# EasyEDA Pro project 电子指南针-git.eprj, schematic Schematic1_4
Create Date: 2024-09-02; Page Name: P1; Project Name: 电子指南针-git; Schematic Name: Schematic1_4; Update Date: 2024-09-07; Company: 嘉立创EDA; Page Size: A4; Version: V1.0
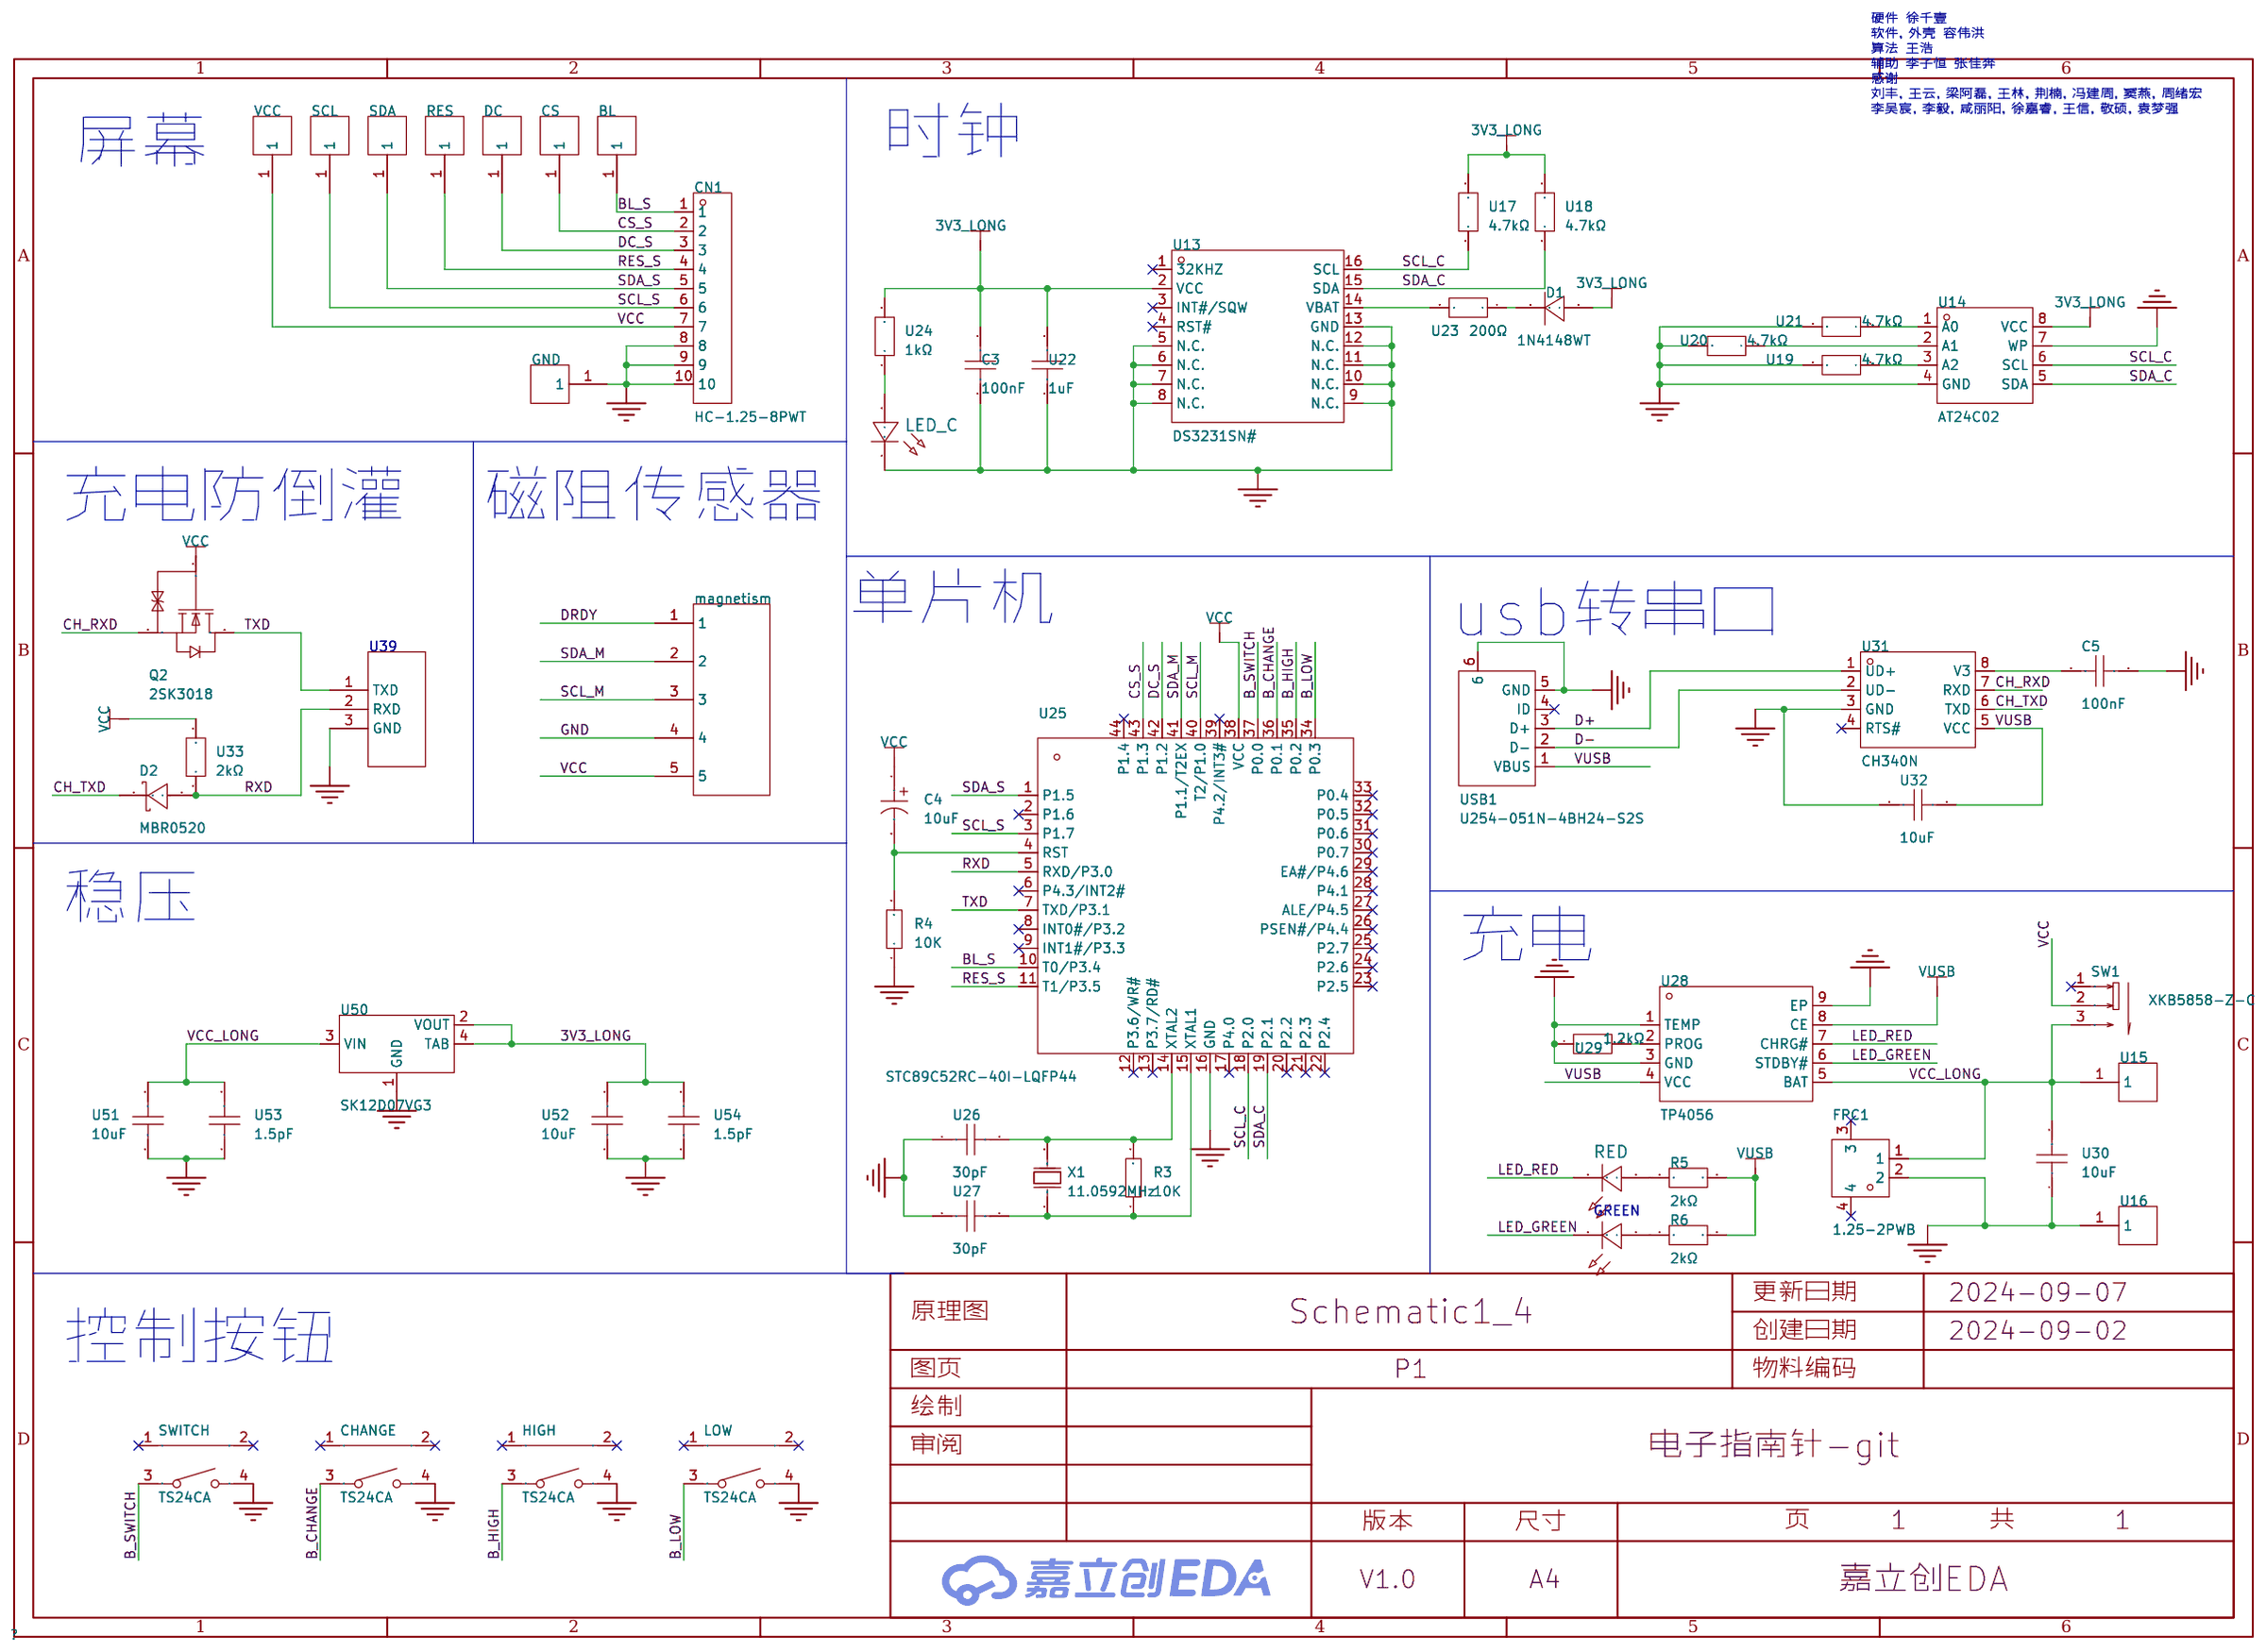
[diagram p1: schematic sheet]

## Parts
BL  -  [mini焊盘]
C3  100nF  [C0603]
C4  10uF  [CAP-SMD_BD5.0-L5.3-W5.3-FD]
C5  100nF  [C0603]
CHANGE  TS24CA  [SW-SMD_TS24CA]
CN1  HC-1.25-8PWT  [CONN-SMD_HC-1.25-8PWT]
CS  -  [mini焊盘]
D1  1N4148WT  [SOD-523_L1.2-W0.8-LS1.6-RD]
D2  MBR0520  [SOD-123_L2.8-W1.8-LS3.7-RD]
DC  -  [mini焊盘]
FPC1  1.25-2PWB  [CONN-SMD_2P-P1.25_DEALON_1.25-2PWB]
GND  -  [mini焊盘]
GREEN  -  [LED_0603]
HIGH  TS24CA  [SW-SMD_TS24CA]
LED_C  -  [LED_0603]
LOW  TS24CA  [SW-SMD_TS24CA]
magnetism  -  [5插件焊盘 间距2.6mm]
Q2  2SK3018  [SOT-23-3_L2.9-W1.3-P1.90-LS2.4-BR]
R3  10K  [R0603]
R4  10K  [R0603]
R5  2kΩ  [R0603]
R6  2kΩ  [R0603]
RED  -  [LED_0603]
RES  -  [mini焊盘]
SCL  -  [mini焊盘]
SDA  -  [mini焊盘]
SW1  XKB5858-Z-C  [SW-TH_XKB5858-Z-C]
SWITCH  TS24CA  [SW-SMD_TS24CA]
U13  DS3231SN#  [SOIC-16_L10.3-W7.5-P1.27-LS10.3-BL]
U14  AT24C02  [SOP-8_L5.0-W4.0-P1.27-LS6.0-BL]
U15  -  [小焊盘]
U16  -  [小焊盘]
U17  4.7kΩ  [R0603]
U18  4.7kΩ  [R0603]
U19  4.7kΩ  [R0603]
U20  4.7kΩ  [R0603]
U21  4.7kΩ  [R0603]
U22  1uF  [C0603]
U23  200Ω  [R0603]
U24  1kΩ  [R0603]
U25  STC89C52RC-40I-LQFP44  [LQFP-44_L10.0-W10.0-P0.80-LS12.0-BL]
U26  30pF  [C0603]
U27  30pF  [C0603]
U28  TP4056  [ESOP-8_L4.9-W3.9-P1.27-LS6.0-BL-EP]
U29  1.2kΩ  [R0603]
U30  10uF  [C0603]
U31  CH340N  [SOP-8_L4.9-W3.9-P1.27-LS6.0-BL]
U32  10uF  [C0603]
U33  2kΩ  [R0603]
U39  -  [下载调试点]
U50  SK12D07VG3  [SOT-223-4_L6.5-W3.5-P2.30-LS7.0-BR]
U51  10uF  [C0603]
U52  10uF  [C0603]
U53  1.5pF  [C0603]
U54  1.5pF  [C0603]
USB1  U254-051N-4BH24-S2S  [MICRO-USB-SMD_U254-051N-4BH24-S2]
VCC  -  [mini焊盘]
X1  11.0592MHz  [OSC-SMD_L5.0-W3.2]

## Library data of the parts
BL CS DC GND RES SCL SDA VCC = mini焊盘
C3 C5 = CC0603MRX7R8BB104: 容值:100nF;精度:±20%;额定电压:25V;材质(温度系数):X7R;; LCSC Part Name: 100nF ±20% 25V; Supplier Part: C2168700; Manufacturer: YAGEO(国巨); Supplier Footprint: 0603; JLCPCB Part Class: 扩展库; Datasheet: https://atta.szlcsc.com/upload/public/pdf/source/20210719/C2168700_6F9BA09EFF30F5F4DF080A6176FF7130.pdf; Supplier: LCSC; Tolerance: ±20%; Voltage Rated: 25V; Temperature Coefficient: X7R
C4 = RST10UF50V016: 容值:10uF;精度:±20%;额定电压:50V;纹波电流:24mA@120Hz;等效串联电阻:-;; LCSC Part Name: 10uF ±20% 50V; Supplier Part: C4747971; Manufacturer: KNSCHA(科尼盛); Supplier Footprint: SMD,D5xL5.4mm; Datasheet: https://atta.szlcsc.com/upload/public/pdf/source/20220722/47144637C831FC4476CE4962252D8002.pdf; Supplier: LCSC; Tolerance: ±20%; Rated Voltage: 50V; Ripple Current: 24mA@120Hz; φD: 5mm; L: 5.4mm; Lifetime @ Temp: 2000hrs@105℃; Operating Temperature: -40℃~+105℃
CHANGE HIGH LOW SWITCH = TS24CA: 电路结构:单刀单掷;按钮形状:矩形按钮;安装方式:卧贴;开关长度:4.55mm;开关宽度:1.8mm;开关高度:3.5mm;触点电流:50mA;额定电压(DC):12V;带灯:-;机械寿命:-;; LCSC Part Name: 4.55*1.8*3.5mm 卧贴 轻触开关; Supplier Part: C393942; Manufacturer: SHOU HAN(首韩); Supplier Footprint: SMD; JLCPCB Part Class: 扩展库; Datasheet: https://atta.szlcsc.com/upload/public/pdf/source/20190521/C393942_591A9E318887EFA4274D34029981AD99.pdf; Supplier: LCSC; Circuit: 单刀单掷; Actuator Style: 矩形按钮; Mounting Style: 卧贴; Switch Length: 4.55mm; Switch Width: 1.8mm; Switch Height: 3.5mm; Contact Current: 50mA; Voltage Rating (DC): 12V
CN1 = HC-1.25-8PWT: 插针结构:1x8P;间距:1.25mm;安装方式:卧贴;参考系列:-;总PIN数:8P;排数:1;每排PIN数:8;行距:-;额定电流:2A;触头材质:黄铜;触头镀层:锡;工作温度范围:-25℃~+85℃;; LCSC Part Name: 1x8P 间距:1.25mm 卧贴; Supplier Part: C2845385; Manufacturer: HCTL(华灿天禄); Supplier Footprint: SMD,P=1.25mm,卧贴; JLCPCB Part Class: 扩展库; Datasheet: https://atta.szlcsc.com/upload/public/pdf/source/20230707/D26CCCA63A4ED0B68E63A615510D7FF9.pdf; Supplier: LCSC; Pins Structure: 1x8P; Pitch: 1.25mm; Mounting Style: 卧贴; Number of Pins: 8P; Number of Rows: 1; Number of PINs Per Row: 8; Current Rating (Max): 2A; Contact Material: 黄铜; Contact Plating: 锡; Operating Temperature Range: -25℃~+85℃
D1 = 1N4148WT_C511874: 二极管配置:独立式;正向压降(Vf):1.25V@100mA;直流反向耐压(Vr):75V;平均整流电流(Io):150mA;功率:500mW;反向恢复时间(trr):4ns;; LCSC Part Name: 电压:75V 电流:150mA; Supplier Part: C511874; Manufacturer: BORN(伯恩半导体); Supplier Footprint: SOD-523; JLCPCB Part Class: 扩展库; Datasheet: https://atta.szlcsc.com/upload/public/pdf/source/20231124/700D00FEEEDC0BE57164827DCFA7C3B0.pdf; Supplier: LCSC; Diode Configuration: 独立式; Forward Voltage (Vf@If): 1.25V@100mA; Reverse Voltage (Vr): 75V; Average Rectified Current (Io): 150mA; Power Dissipation: 500mW; Reverse Leakage Current: 5uA@75V; Reverse Recovery Time (trr): 4ns
D2 = MBR0520_C77335: 正向压降(Vf):450mV@500mA;直流反向耐压(Vr):20V;平均整流电流(Io):500mA;; LCSC Part Name: 电压:20V 电流:500mA; Supplier Part: C77335; Manufacturer: CJ(江苏长电/长晶); Supplier Footprint: SOD-123; JLCPCB Part Class: 扩展库; Datasheet: https://atta.szlcsc.com/upload/public/pdf/source/20160702/1467448303432.pdf; Supplier: LCSC; Forward Voltage (Vf@If): 450mV@500mA; Reverse Voltage (Vr): 20V; Average Rectified Current (Io): 500mA
FPC1 = 1.25-2PWB: 插针结构:1x2P;间距:1.25mm;安装方式:卧贴;参考系列:-;总PIN数:2P;排数:1;每排PIN数:2;行距:-;额定电流:-;工作温度范围:-40℃~+85℃;; LCSC Part Name: 1x2P 间距:1.25mm 卧贴; Supplier Part: C2905009; Manufacturer: DEALON(德艺隆); Supplier Footprint: SMD,P=1.25mm,卧贴; JLCPCB Part Class: 扩展库; Datasheet: https://atta.szlcsc.com/upload/public/pdf/source/20231123/1AE0876AE9C7DCFC0D68EAC4CBA881B0.pdf; Supplier: LCSC; Pins Structure: 1x2P; Pitch: 1.25mm; Mounting Style: 卧贴; Number of Pins: 2P; Number of Rows: 1; Number of PINs Per Row: 2; Operating Temperature Range: -40℃~+85℃
GREEN = LED_0603-G: Supplier Footprint: 0603
LED_C RED = LED_0603-R: Supplier Footprint: 0603
magnetism = 5插件焊盘 间距2.6mm
Q2 = 2SK3018_C8562: 类型:1个N沟道;漏源电压(Vdss):30V;连续漏极电流(Id):100mA;功率(Pd):350mW;导通电阻(RDS(on)@Vgs,Id):8Ω@4V,10mA;阈值电压(Vgs(th)@Id):1.5V@100uA;; LCSC Part Name: 1个N沟道 耐压:30V 电流:100mA; Supplier Part: C8562; Manufacturer: CJ(江苏长电/长晶); Supplier Footprint: SOT-23; JLCPCB Part Class: 扩展库; Datasheet: https://atta.szlcsc.com/upload/public/pdf/source/20140809/1457707215233.pdf; Supplier: LCSC; Type: 1个N沟道; Drain Source Voltage (Vdss): 30V; Continuous Drain Current (Id): 100mA; Power Dissipation (Pd): 350mW; Drain Source On Resistance (RDS(on)@Vgs,Id): 8Ω@4V,10mA; Gate Threshold Voltage (Vgs(th)@Id): 1.5V@100uA
R3 R4 = Res_0603: Supplier Footprint: 0603
R5 R6 = PTFR0603Q2K00N9: 电阻类型:薄膜电阻;阻值:2kΩ;精度:±0.02%;功率:100mW;最大工作电压:100V;温度系数:±10ppm/℃;; LCSC Part Name: 薄膜电阻 2kΩ ±0.02% 100mW; Supplier Part: C23067435; Manufacturer: RESI(开步睿思); Supplier Footprint: 0603; Datasheet: https://atta.szlcsc.com/upload/public/pdf/source/20240628/611D196B6AD2D0BC173B189B37FFA8DD.pdf; Supplier: LCSC; Type: 薄膜电阻; Tolerance: ±0.02%; Power(Watts): 100mW; Overload Voltage (Max): 100V; Temperature Coefficient: ±10ppm/℃; Operating Temperature Range: -55℃~+155℃
SW1 = XKB5858-Z-C: 电路结构:-;自锁/无锁:自锁;安装方式:卧插;触点电流:100mA;额定电压 (AC):250V;额定电压 (DC):30V;带灯:不带;作用力:160gf;机械寿命:1万次;; LCSC Part Name: 按键开关  5.8*5.8侧边插脚自锁; Supplier Part: C318865; Manufacturer: XKB Connectivity(中国星坤); Supplier Footprint: 插件; JLCPCB Part Class: 扩展库; Datasheet: https://atta.szlcsc.com/upload/public/pdf/source/20200227/C318865_806C1898A28533892EA4A080484E0BBB.pdf; Supplier: LCSC; Self Lock / No Lock: 自锁; Actuator Style: 矩形按钮; Mounting Style: 卧插; Contact Current: 100mA; Voltage Rating (AC): 250V; Voltage Rating (DC): 30V; Insulation Resistance: 100MΩ; Actuator/Cap Color: 白色; With Lamp: 不带; Pin Style: PC引脚; Operating Force: 160gf; Operating Temperature: -15℃~+55℃; Mechanical Life: 1万次
U13 = DS3231SN#: 接口:I2C;; Supplier Part: C722469; Manufacturer: ADI(亚德诺)/MAXIM(美信); Supplier Footprint: SOIC-16-300mil; JLCPCB Part Class: 扩展库; Datasheet: https://atta.szlcsc.com/upload/public/pdf/source/20170713/C118524_1499918908819816807.pdf; Supplier: LCSC; Interface: I2C; Operating Voltage: 2.3V~5.5V; Operating Temperature: -40℃~+85℃
U14 = AT24C02_C688857: Supplier Part: C688857; Manufacturer: IDCHIP(英锐芯); Supplier Footprint: SOP-8; JLCPCB Part Class: 扩展库; Datasheet: https://atta.szlcsc.com/upload/public/pdf/source/20200619/C688857_168265888F77B455D6D4136881F4BB15.pdf; Supplier: LCSC
U15 U16 = 小焊盘
U17-U21 = TD03H4701BT: 电阻类型:薄膜电阻;阻值:4.7kΩ;精度:±0.1%;功率:100mW;最大工作电压:-;温度系数:±50ppm/℃;; LCSC Part Name: 薄膜电阻 4.7kΩ ±0.1% 100mW; Supplier Part: C2961385; Manufacturer: FH(风华); Supplier Footprint: 0603; JLCPCB Part Class: 扩展库; Datasheet: https://atta.szlcsc.com/upload/public/pdf/source/20200814/C723338_D21265282435396FB133F134A60939A5.pdf; Supplier: LCSC; Type: 薄膜电阻; Tolerance: ±0.1%; Power(Watts): 100mW; Temperature Coefficient: ±50ppm/℃; Operating Temperature Range: -55℃~+155℃
U22 = TCC0603X7R105K500CT: 容值:1uF;精度:±10%;额定电压:50V;材质(温度系数):X7R;; LCSC Part Name: 1uF ±10% 50V; Supplier Part: C5360793; Manufacturer: CCTC(三环); Supplier Footprint: 0603; JLCPCB Part Class: 扩展库; Datasheet: https://atta.szlcsc.com/upload/public/pdf/source/20191203/C466239_F62A586702D44EEA1C39B32FC8662B21.pdf; Supplier: LCSC; Tolerance: ±10%; Voltage Rated: 50V; Temperature Coefficient: X7R
U23 = CRCW0603200RFKEAHP: 电阻类型:厚膜电阻;阻值:200Ω;精度:±1%;功率:333mW;温度系数:±100ppm/℃;; LCSC Part Name: 厚膜电阻 200Ω ±1% 333mW; Supplier Part: C313701; Manufacturer: VISHAY(威世); Supplier Footprint: 0603; JLCPCB Part Class: 扩展库; Datasheet: https://atta.szlcsc.com/upload/public/pdf/source/20220523/F81E80130AF826FE1224249A473E2E22.pdf; Supplier: LCSC; Type: 厚膜电阻; Tolerance: ±1%; Power(Watts): 333mW; Temperature Coefficient: ±100ppm/℃; Operating Temperature Range: -55℃~+155℃
U24 = CRCW06031K00JNEAC: 电阻类型:厚膜电阻;阻值:1kΩ;精度:±5%;功率:100mW;最大工作电压:75V;温度系数:±200ppm/℃;; LCSC Part Name: 厚膜电阻 1kΩ ±5% 100mW; Supplier Part: C844135; Manufacturer: VISHAY(威世); Supplier Footprint: 0603; JLCPCB Part Class: 扩展库; Datasheet: https://atta.szlcsc.com/upload/public/pdf/source/20210813/0DF91ED8A55BB3B23A2DB757E3871E21.pdf; Supplier: LCSC; Type: 厚膜电阻; Tolerance: ±5%; Power(Watts): 100mW; Overload Voltage (Max): 75V; Temperature Coefficient: ±200ppm/℃; Operating Temperature Range: -55℃~+155℃
U25 = STC89C52RC-40I-LQFP44: CPU内核:51系列;程序存储容量:8KB;RAM总容量:512Byte;GPIO端口数量:39;工作电压范围:3.3V~5.5V;CPU最大主频:-;程序存储器类型:FLASH;; Supplier Part: C8707; Manufacturer: STC(宏晶); Supplier Footprint: LQFP-44(10x10); Datasheet: https://atta.szlcsc.com/upload/public/pdf/source/20131218/1457706663573.pdf; Supplier: LCSC; CPU Core: 51系列; Program Storage Size: 8KB; RAM Size: 512Byte; GPIO Ports Number: 39; Operating Voltage Range: 3.3V~5.5V; Program Memory Type: FLASH; Operating Temperature Range: -40℃~+85℃; 16Bit Timer: 3; UART/USART: 1; Peripheral/Function: 看门狗; Watchdog: 有
U26 U27 = FCC0603N300J500CT: 容值:30pF;精度:±5%;额定电压:50V;材质(温度系数):C0G;; LCSC Part Name: 30pF ±5% 50V; Supplier Part: C7419422; Manufacturer: FOJAN(富捷); Supplier Footprint: 0603; Datasheet: https://atta.szlcsc.com/upload/public/pdf/source/20230926/96CBFEAC228090559554C216363F8731.pdf; Supplier: LCSC; Tolerance: ±5%; Voltage Rated: 50V; Temperature Coefficient: C0G
U28 = TP4056_C382139: LCSC Part Name: 1A锂电池充电IC; Supplier Part: C382139; Manufacturer: TPOWER(天源); Supplier Footprint: ESOP-8; JLCPCB Part Class: 扩展库; Datasheet: https://atta.szlcsc.com/upload/public/pdf/source/20190327/C382139_EC85960E6FE3E26856C240C81751A184.pdf; Supplier: LCSC
U29 = RT0603BRB071K2L: 电阻类型:薄膜电阻;阻值:1.2kΩ;精度:±0.1%;功率:100mW;温度系数:±10ppm/℃;; LCSC Part Name: 薄膜电阻 1.2kΩ ±0.1% 100mW; Supplier Part: C860190; Manufacturer: YAGEO(国巨); Supplier Footprint: 0603; JLCPCB Part Class: 扩展库; Datasheet: https://atta.szlcsc.com/upload/public/pdf/source/20200610/C326738_5639A9F1B6EB6E4AE2197577D3456E7F.pdf; Supplier: LCSC; Type: 薄膜电阻; Tolerance: ±0.1%; Power(Watts): 100mW; Temperature Coefficient: ±10ppm/℃; Operating Temperature Range: -55℃~+155℃
U30 U32 U51 U52 = HGC0603R5106M350NTHJ: 容值:10uF;精度:±20%;额定电压:35V;材质(温度系数):X5R;; LCSC Part Name: 10uF ±20% 35V; Supplier Part: C22367827; Manufacturer: Chinocera(华瓷); Supplier Footprint: 0603; JLCPCB Part Class: 扩展库; Datasheet: https://atta.szlcsc.com/upload/public/pdf/source/20240326/08136F0414FFF46DD07E47F2D66E675E.pdf; Supplier: LCSC; Tolerance: ±20%; Voltage Rated: 35V; Temperature Coefficient: X5R
U31 = CH340N: LCSC Part Name: USB转串口芯片 CH340; Supplier Part: C2977777; Manufacturer: WCH(南京沁恒); Supplier Footprint: SOP-8; JLCPCB Part Class: 扩展库; Datasheet: https://atta.szlcsc.com/upload/public/pdf/source/20230530/6E401E9554E9F5311886CC8B3F89B62E.pdf; Supplier: LCSC
U33 = CRCW06032K00FKEAHP: 电阻类型:厚膜电阻;阻值:2kΩ;精度:±1%;功率:333.333mW;最大工作电压:75V;温度系数:±100ppm/℃;; LCSC Part Name: 厚膜电阻 2kΩ ±1% 333.333mW; Supplier Part: C313719; Manufacturer: VISHAY(威世); Supplier Footprint: 0603; JLCPCB Part Class: 扩展库; Datasheet: https://atta.szlcsc.com/upload/public/pdf/source/20210128/C313329_30EDDB0DCE34428579C0BE4C994F6084.pdf; Supplier: LCSC; Type: 厚膜电阻; Tolerance: ±1%; Power(Watts): 333.333mW; Overload Voltage (Max): 75V; Temperature Coefficient: ±100ppm/℃; Operating Temperature Range: -55℃~+155℃
U39 = 下载调试点（有封装）
U50 = AMS1117-3.3V: 输出类型:固定;输出极性:正;输出通道数:1;最大输入电压:18V;输出电压:3.3V;压差:1.3V@(1A);输出电流:1A;电源纹波抑制比(PRSS):60dB@(120Hz);; Supplier Part: C347222; Supplier Footprint: SOT-223; JLCPCB Part Class: 扩展库; Datasheet: https://atta.szlcsc.com/upload/public/pdf/source/20160702/1467448296695.pdf; Supplier: LCSC
U53 U54 = C1608C0G2A1R5C080AA: 容值:1.5pF;额定电压:100V;材质(温度系数):C0G;; LCSC Part Name: 1.5pF 100V; Supplier Part: C3873107; Manufacturer: TDK; Supplier Footprint: 0603; JLCPCB Part Class: 扩展库; Datasheet: https://atta.szlcsc.com/upload/public/pdf/source/231023/files-179e77ec57705f1f6a0fa868e4e425d4.pdf; Supplier: LCSC; Voltage Rated: 100V; Temperature Coefficient: C0G
USB1 = U254-051N-4BH24-S2S: 连接器类型:Micro-B;标准:USB 2.0;公母:母;安装方式:卧贴;触点数量:5P;端口数量:1;额定电流 - 电源:1.8A;触头材质:铜合金;触头镀层:金;工作温度范围:-40℃~+85℃;焊接温度(最大值):260℃;; LCSC Part Name: Micro-B 母 卧贴; Supplier Part: C692421; Manufacturer: XKB Connection(中国星坤); Supplier Footprint: SMD; JLCPCB Part Class: 扩展库; Datasheet: https://atta.szlcsc.com/upload/public/pdf/source/20211011/B206D16459F712703796869A87C6FBF1.pdf; Supplier: LCSC; Connector Type: Micro-B; Standard: USB 2.0; Gender: 母; Mounting Style: 卧贴; Number of Contacts: 5P; Number of Ports: 1; Current Rating - Power (Max): 1.8A; Contact Material: 铜合金; Contact Plating: 金; Operating Temperature Range: -40℃~+85℃; Soldering Temperature(Max): 260℃
X1 = X5032110592MSB2GI: 晶振类型:贴片晶振;频率:11.0592MHz;常温频差:±10ppm;外接负载电容:20pF;频率稳定度(全温):±20ppm;; LCSC Part Name: 11.0592MHz ±10ppm 20pF; Supplier Part: C112574; Manufacturer: YXC(扬兴晶振); Supplier Footprint: SMD5032; JLCPCB Part Class: 扩展库; Datasheet: https://atta.szlcsc.com/upload/public/pdf/source/20240329/44922B0AF7B60E58E9B66993B6077277.pdf; Supplier: LCSC; Crystal Type: 贴片晶振; Normal temperature Frequency Tolerance: ±10ppm; External load capacitor: 20pF; Frequency Stability(Full temperature range): ±20ppm; Operating Temperature: -40℃~+85℃

## Nets
3V3_LONG: C3.2 D1.2(A) U13.2(VCC) U14.8(VCC) U17.2 U18.2 U22.2 U24.2 U50.2(VOUT) U50.4(TAB) U52.2 U54.2
GND: C3.1 C5.2 CHANGE.4 CN1.8 CN1.9 CN1.10 FPC1.2 GND.1 HIGH.4 LED_C.1(C) LOW.4 magnetism.4 R4.1 SWITCH.4 U13.5(N.C.) U13.6(N.C.) U13.7(N.C.) U13.8(N.C.) U13.9(N.C.) U13.10(N.C.) U13.11(N.C.) U13.12(N.C.) U13.13(GND) U14.4(GND) U14.7(WP) U16.1 U19.2 U20.2 U21.2 U22.1 U25.16(GND) U26.1 U27.1 U28.1(TEMP) U28.3(GND) U28.9(EP) U29.1 U30.1 U31.3(GND) U32.1 U39.3(GND) U50.1(GND) U51.1 U52.1 U53.1 U54.1 USB1.5(GND) USB1.6
VCC: C4.1 CN1.7 magnetism.5 Q2.1(G) SW1.2 U25.38(VCC) U33.2 VCC.1
VCC_LONG: FPC1.1 SW1.3 U15.1 U28.5(BAT) U30.2 U50.3(VIN) U51.2 U53.2
B_CHANGE: CHANGE.3 U25.36(P0.1)
B_HIGH: HIGH.3 U25.35(P0.2)
B_LOW: LOW.3 U25.34(P0.3)
B_SWITCH: SWITCH.3 U25.37(P0.0)
BL_S: BL.1 CN1.1 U25.10(T0/P3.4)
CH_RXD: Q2.2(S) U31.7(RXD)
CH_TXD: D2.1(K) U31.6(TXD)
CS_S: CN1.2 CS.1 U25.43(P1.3)
D+: U31.1(UD+) USB1.3(D+)
D-: U31.2(UD-) USB1.2(D-)
DC_S: CN1.3 DC.1 U25.42(P1.2)
DRDY: magnetism.1
LED_GREEN: GREEN.1(C) U28.6(STDBY#)
LED_RED: RED.1(C) U28.7(CHRG#)
RES_S: CN1.4 RES.1 U25.11(T1/P3.5)
RXD: D2.2(A) U25.5(RXD/P3.0) U33.1 U39.2(RXD)
SCL_C: U13.16(SCL) U14.6(SCL) U17.1 U25.18(P2.0)
SCL_M: magnetism.3 U25.40(T2/P1.0)
SCL_S: CN1.6 SCL.1 U25.3(P1.7)
SDA_C: U13.15(SDA) U14.5(SDA) U18.1 U25.19(P2.1)
SDA_M: magnetism.2 U25.41(P1.1/T2EX)
SDA_S: CN1.5 SDA.1 U25.1(P1.5)
TXD: Q2.3(D) U25.7(TXD/P3.1) U39.1(TXD)
VUSB: R5.2 R6.2 U28.4(VCC) U28.8(CE) U31.5(VCC) U32.2 USB1.1(VBUS)
$1N3332: U13.14(VBAT) U23.2
$1N3666: U14.1(A0) U21.1
$1N3668: U14.3(A2) U19.1
$1N3672: U14.2(A1) U20.1
$1N4126: D1.1(K) U23.1
$1N4226: LED_C.2(A) U24.1
$1N5582: R3.2 U25.14(XTAL2) U26.2 X1.2(OSC2)
$1N5600: R3.1 U25.15(XTAL1) U27.2 X1.1(OSC1)
$1N5639: C4.2 R4.2 U25.4(RST)
$1N6255: U28.2(PROG) U29.2
$1N6689: C5.1 U31.8(V3)
$1N29996: R5.1 RED.2(A)
$1N30158: GREEN.2(A) R6.1

Not connected (* = marked no-connect by the designer): CHANGE 1* 2*; FPC1 3* 4*; HIGH 1* 2*; LOW 1* 2*; SW1 1*; SWITCH 1* 2*; U13 1(32KHZ)* 3(INT#/SQW)* 4(RST#)*; U25 2(P1.6)* 6(P4.3/INT2#)* 8(INT0#/P3.2)* 9(INT1#/P3.3)* 12(P3.6/WR#)* 13(P3.7/RD#)* 17(P4.0)* 20(P2.2)* 21(P2.3)* 22(P2.4)* 23(P2.5)* 24(P2.6)* 25(P2.7)* 26(PSEN#/P4.4)* 27(ALE/P4.5)* 28(P4.1)* 29(EA#/P4.6)* 30(P0.7)* 31(P0.6)* 32(P0.5)* 33(P0.4)* 39(P4.2/INT3#)* 44(P1.4)*; U31 4(RTS#)*; USB1 4(ID)*

## Notes on the sheet
- 硬件 徐千壹
  软件，外壳 容伟洪
  算法 王浩
  辅助 李子恒 张佳奔
  感谢
  刘丰，王云，梁阿磊，王林，荆楠，冯建周，窦燕，周绪宏
  李吴宸，李毅，咸丽阳，徐嘉睿，王信，敬硕，袁梦强
- 屏幕
- 时钟
- 充电防倒灌
- 磁阻传感器
- 单片机
- usb转串口
- 稳压
- 充电
- 控制按钮
